# EasyEDA Pro project YanQi_Project.eprj, board PayloadBoard
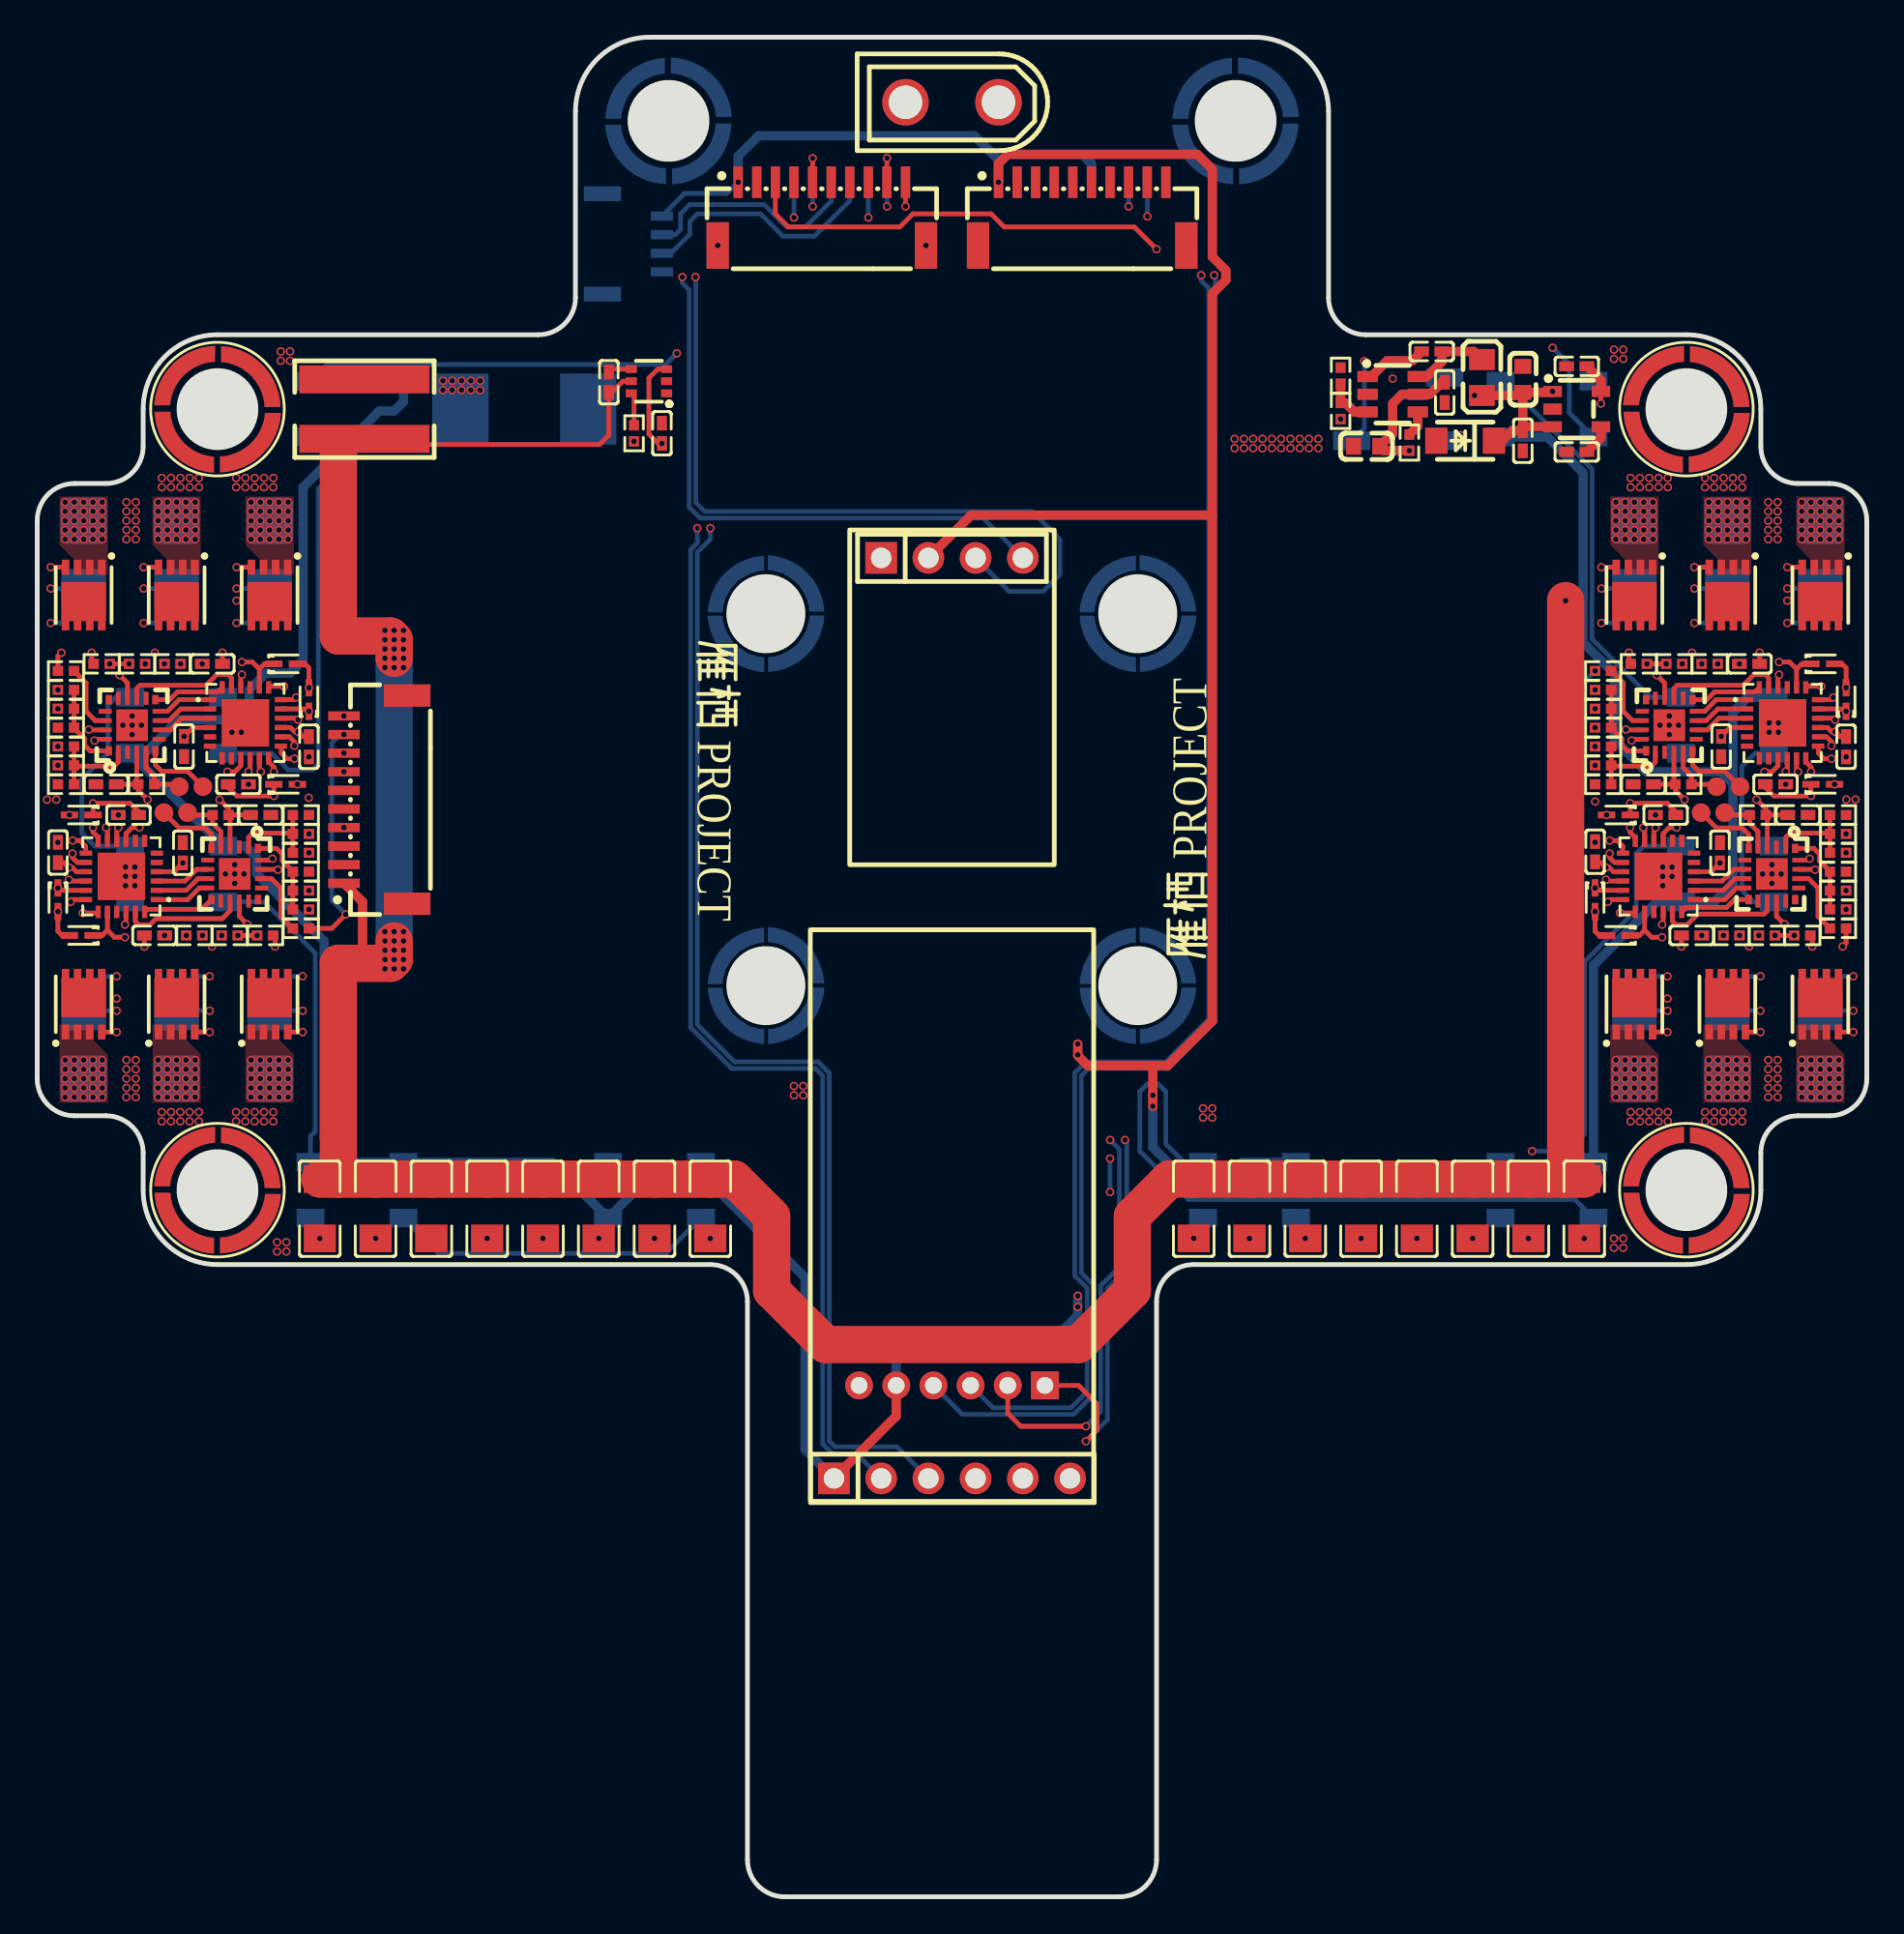
[diagram p6: board, top side]
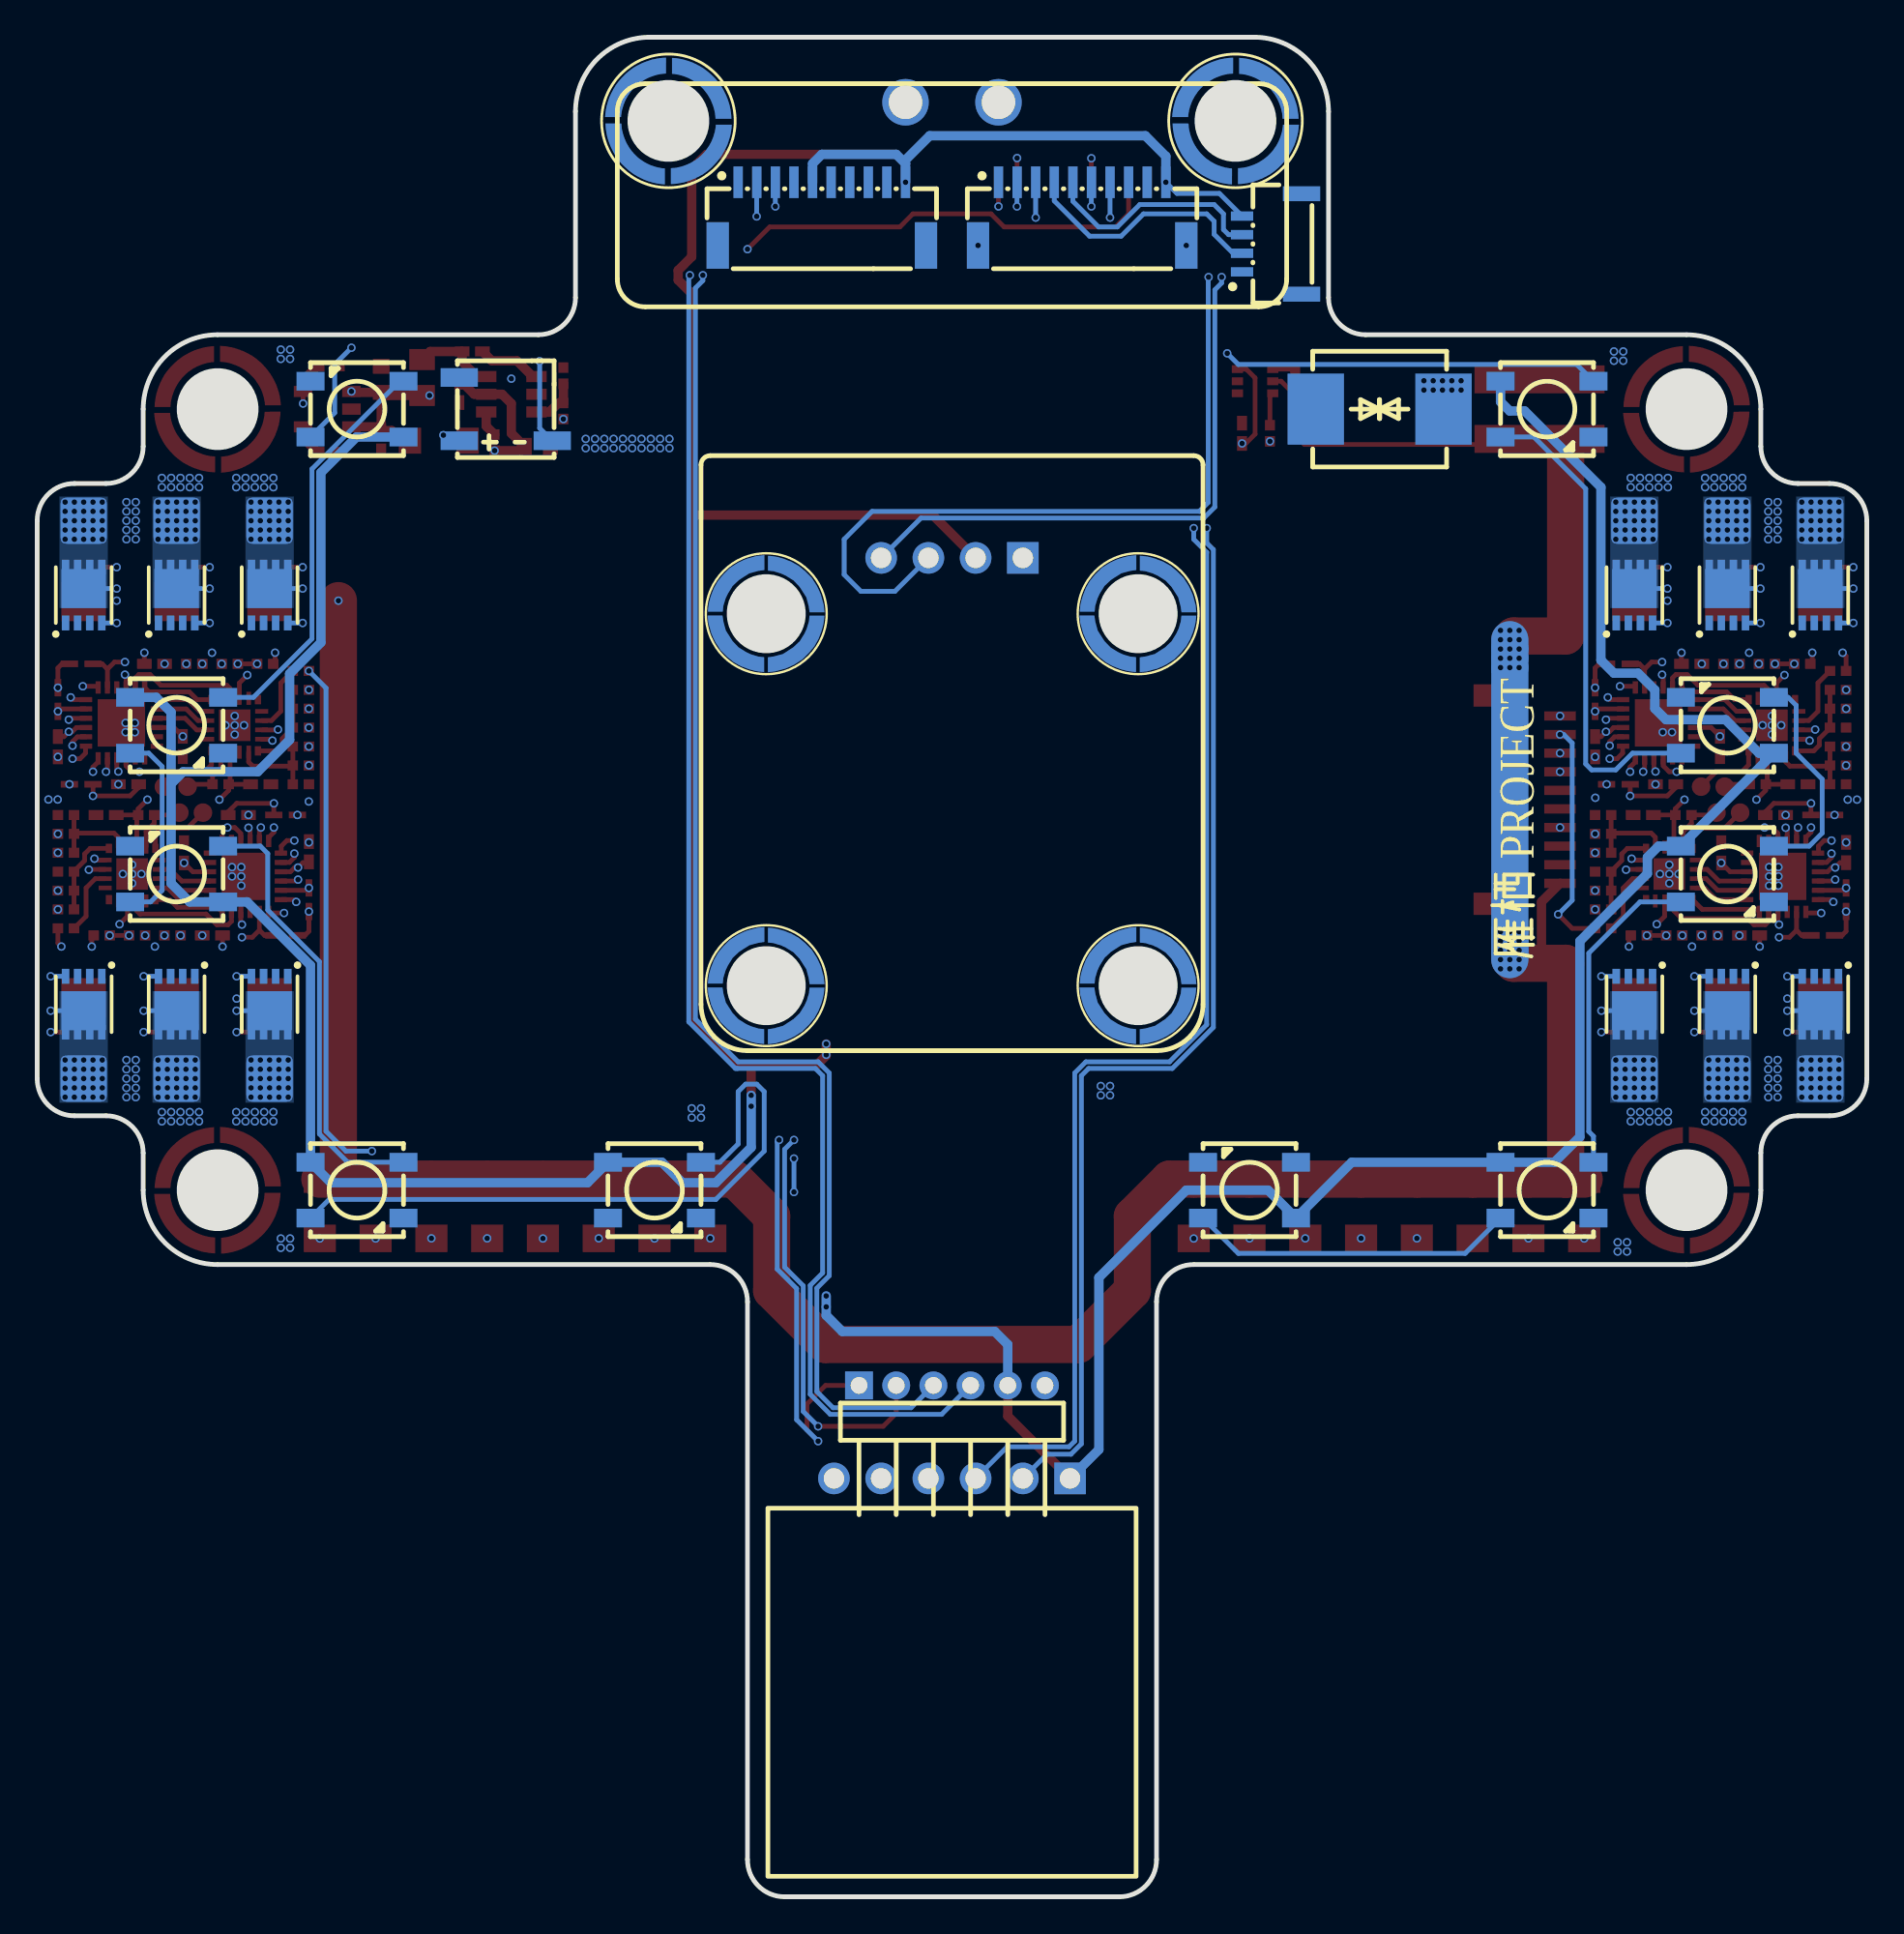
[diagram p7: board, bottom side, seen from below]

Outline 98.4 x 100 mm; copper layers: Top Layer, Inner1, Inner2, Bottom Layer. Coordinates in mm from the lower left corner of the outline.
Outline path: 0,74 0,44 arc(0.59,42.59) 2,42 3.7,42 arc(5.11,41.41) 5.7,40 5.7,38 arc(6.87,35.17) 9.7,34 36.2,34 arc(37.61,33.41) 38.2,32 38.2,2 arc(38.79,0.59) 40.2,0 58.2,0 arc(59.61,0.59) 60.2,2 60.2,32 arc(60.79,33.41) 62.2,34 88.7,34 arc(91.53,35.17) 92.7,38 92.7,40 arc(93.29,41.41) 94.7,42 96.4,42 arc(97.81,42.59) 98.4,44 98.4,74 arc(97.81,75.41) 96.4,76 94.7,76 arc(93.29,76.59) 92.7,78 92.7,80 arc(91.53,82.83) 88.7,84 71.45,84 arc(70.04,84.59) 69.45,86 69.45,96 arc(68.28,98.83) 65.45,100 32.95,100 arc(30.12,98.83) 28.95,96 28.95,86 arc(28.36,84.59) 26.95,84 9.7,84 arc(6.87,82.83) 5.7,80 5.7,78 arc(5.11,76.59) 3.7,76 2,76 arc(0.59,75.41) 0,74
Stack: Top Layer 0.035mm / Dielectric1 0.48mm PP er 4.5 / Inner1 0.035mm / Dielectric2 0.48mm FR4 er 4.5 / Inner2 0.035mm / Dielectric3 0.48mm PP er 4.5 / Bottom Layer 0.035mm

## Design rules (mm)
template: 自定义配置
spacing copperThickness1oz (default): track to track 0.102, other pairs 0.152 to 0.3
spacing copperThickness2oz: track to track 0.203, other pairs 0.152 to 0.3
spacing copperThicknessInner0.5oz: track to track 0.089, other pairs 0.152 to 0.3
track width copperThickness1oz (default): min 0.102, default 0.254, max 10
track width copperThickness2oz: min 0.203, default 0.254, max 10
track width copperThickness0.5oz: min 0.089, default 0.254, max 10
differential pair differentialPair (default): width min 0.127, default 0.254, max 2.54; gap min 0.152, default 0.152
via viaSize (default): diameter min 0.3, default 0.45, max 10; hole min 0.2, default 0.3, max 6.3

## Placement (name value [footprint] x y rotation side)
BUZZER1  4000Hz  [BUZ-SMD_4P-L5.0-W5.0-P4.00-BR]  73.2 80 270 bottom
C1  1uF  [C0402]  92.09 66.3 180 top
C2  1uF  [C0402]  97.29 61.84 270 top
C3  100nF  [C0402_NEW]  86.38 59.83 180 top
C4  100nF  [C0402_NEW]  90.57 61.86 90 top
C5  1uF  [C0402]  93.49 59.83 180 top
C6  1uF  [C0402]  6.31 51.7 0 top
C7  1uF  [C0402]  1.12 56.16 90 top
C8  100nF  [C0402_NEW]  12.02 58.17 0 top
C9  100nF  [C0402_NEW]  7.83 56.14 270 top
C10  1uF  [C0402]  4.91 58.17 0 top
C11  1uF  [C0402]  9.42 66.3 180 top
C12  1uF  [C0402]  14.61 61.84 270 top
C13  100nF  [C0402_NEW]  3.71 59.83 180 top
C14  100nF  [C0402_NEW]  7.9 61.86 90 top
C15  1uF  [C0402]  10.82 59.83 180 top
C16  1uF  [C0402]  88.98 51.7 0 top
C17  1uF  [C0402]  83.79 56.2 90 top
C18  100nF  [C0402_NEW]  94.69 58.17 0 top
C19  100nF  [C0402_NEW]  90.5 56.14 270 top
C20  1uF  [C0402]  87.58 58.17 0 top
C21  100nF  [C0402_NEW]  75 83.1 180 top
C22  100nF  [C0402_NEW]  75.7 80.9 90 top
C23  4.7uF  [C0603]  71.5 78 0 top
C24  10uF  [C0603]  79.9 81.6 270 top
C25  10uF  [C1206]  15.2 37 90 top
C26  10uF  [C1206]  18.2 37 90 top
C27  10uF  [C1206]  21.2 37 90 top
C28  10uF  [C1206]  24.2 37 90 top
C29  10uF  [C1206]  27.2 37 90 top
C30  10uF  [C1206]  30.2 37 90 top
C31  10uF  [C1206]  33.2 37 90 top
C32  10uF  [C1206]  36.2 37 90 top
C33  2.2uF  [C0402]  82.8 82.3 180 top
C34  1uF  [C0402]  79.9 78.3 90 top
C35  100nF  [C0402_NEW]  82.8 77.7 0 top
C36  100nF  [C0402_NEW]  33.6 78.7 270 top
C37  1nF  [C0402]  30.74 81.44 270 top
C38  10uF  [C1206]  62.2 37 90 top
C39  10uF  [C1206]  65.2 37 90 top
C40  10uF  [C1206]  68.2 37 90 top
C41  10uF  [C1206]  71.2 37 90 top
C42  10uF  [C1206]  74.2 37 90 top
C43  10uF  [C1206]  77.2 37 90 top
C44  10uF  [C1206]  80.2 37 90 top
C45  10uF  [C1206]  83.2 37 90 top
CN1  HDGC1002WV-S-4P  [CONN-SMD_4P-P1.00_HDGC_HDGC1002WV-S-4P]  32 88.88 90 bottom
CN2  XT30UPB-M  [CONN-TH_XT30UPB-M]  49.2 96.5 180 top
D1  1N4148WT T4  [SOD-523_L1.2-W0.8-LS1.6-RD]  96.03 66.3 0 top
D2  1N4148WT T4  [SOD-523_L1.2-W0.8-LS1.6-RD]  97.29 64.38 90 top
D3  1N4148WT T4  [SOD-523_L1.2-W0.8-LS1.6-RD]  96.03 59.83 0 top
D4  1N4148WT T4  [SOD-523_L1.2-W0.8-LS1.6-RD]  2.37 51.7 180 top
D5  1N4148WT T4  [SOD-523_L1.2-W0.8-LS1.6-RD]  1.12 53.62 270 top
D6  1N4148WT T4  [SOD-523_L1.2-W0.8-LS1.6-RD]  2.37 58.17 180 top
D7  1N4148WT T4  [SOD-523_L1.2-W0.8-LS1.6-RD]  13.36 66.3 0 top
D8  1N4148WT T4  [SOD-523_L1.2-W0.8-LS1.6-RD]  14.61 64.38 90 top
D9  1N4148WT T4  [SOD-523_L1.2-W0.8-LS1.6-RD]  13.36 59.83 0 top
D10  1N4148WT T4  [SOD-523_L1.2-W0.8-LS1.6-RD]  85.04 51.7 180 top
D11  1N4148WT T4  [SOD-523_L1.2-W0.8-LS1.6-RD]  83.79 53.62 270 top
D12  1N4148WT T4  [SOD-523_L1.2-W0.8-LS1.6-RD]  85.04 58.17 180 top
D13  -  [端口]  95.9 74 180 bottom
D14  -  [端口]  90.9 74 180 bottom
D15  -  [端口]  85.9 74 180 bottom
D16  -  [端口]  12.5 74 180 bottom
D17  -  [端口]  7.5 74 180 bottom
D18  -  [端口]  2.5 74 180 bottom
D19  -  [端口]  2.5 44 180 bottom
D20  -  [端口]  7.5 44 180 bottom
D21  -  [端口]  12.5 44 180 bottom
D22  -  [端口]  85.9 44 180 bottom
D23  -  [端口]  90.9 44 180 bottom
D24  -  [端口]  95.9 44 180 bottom
H1  PZ254V-11-04P  [HDR-TH_4P-P2.54-V-M]  49.2 72 0 top
H2  PZ200-1-06-W  [HDR-TH_6P-P2.00-H-M-W7.2-N]  49.2 27.5 180 bottom
H3  PZ254V-11-06P  [HDR-TH_6P-P2.54-V-M]  49.2 22.5 0 top
L1  6.8uH  [L0805]  77.7 81.7 270 top
LED1  XL-5050RGBC-WS2812B  [LED-SMD_4P-L5.0-W5.0-BL_XL-5050RGBC]  17.2 80 270 bottom
LED2  XL-5050RGBC-WS2812B  [LED-SMD_4P-L5.0-W5.0-BL_XL-5050RGBC]  7.5 63 90 bottom
LED3  XL-5050RGBC-WS2812B  [LED-SMD_4P-L5.0-W5.0-BL_XL-5050RGBC]  7.5 55 270 bottom
LED4  XL-5050RGBC-WS2812B  [LED-SMD_4P-L5.0-W5.0-BL_XL-5050RGBC]  17.2 38 270 bottom
LED5  XL-5050RGBC-WS2812B  [LED-SMD_4P-L5.0-W5.0-BL_XL-5050RGBC]  33.2 38 90 bottom
LED6  XL-5050RGBC-WS2812B  [LED-SMD_4P-L5.0-W5.0-BL_XL-5050RGBC]  65.2 38 270 bottom
LED7  XL-5050RGBC-WS2812B  [LED-SMD_4P-L5.0-W5.0-BL_XL-5050RGBC]  81.2 38 270 bottom
LED8  XL-5050RGBC-WS2812B  [LED-SMD_4P-L5.0-W5.0-BL_XL-5050RGBC]  90.9 55 90 bottom
LED9  XL-5050RGBC-WS2812B  [LED-SMD_4P-L5.0-W5.0-BL_XL-5050RGBC]  90.9 63 270 bottom
LED10  XL-5050RGBC-WS2812B  [LED-SMD_4P-L5.0-W5.0-BL_XL-5050RGBC]  81.2 80 90 bottom
Q1  AON7544  [DFN-8_L3.0-W3.0-P0.65-BL]  95.9 70 180 top
Q2  AON7544  [DFN-8_L3.0-W3.0-P0.65-BL]  90.9 70 180 top
Q3  AON7544  [DFN-8_L3.0-W3.0-P0.65-BL]  85.9 70 180 top
Q4  AON7544  [DFN-8_L3.0-W3.0-P0.65-BL]  12.5 70 180 top
Q5  AON7544  [DFN-8_L3.0-W3.0-P0.65-BL]  7.5 70 180 top
Q6  AON7544  [DFN-8_L3.0-W3.0-P0.65-BL]  2.5 70 180 top
Q7  AON7544  [DFN-8_L3.0-W3.0-P0.65-BL]  95.9 70 180 bottom
Q8  AON7544  [DFN-8_L3.0-W3.0-P0.65-BL]  90.9 70 180 bottom
Q9  AON7544  [DFN-8_L3.0-W3.0-P0.65-BL]  85.9 70 180 bottom
Q10  AON7544  [DFN-8_L3.0-W3.0-P0.65-BL]  12.5 70 180 bottom
Q11  AON7544  [DFN-8_L3.0-W3.0-P0.65-BL]  7.5 70 180 bottom
Q12  AON7544  [DFN-8_L3.0-W3.0-P0.65-BL]  2.5 70 180 bottom
Q13  AON7544  [DFN-8_L3.0-W3.0-P0.65-BL]  2.5 48 0 top
Q14  AON7544  [DFN-8_L3.0-W3.0-P0.65-BL]  7.5 48 0 top
Q15  AON7544  [DFN-8_L3.0-W3.0-P0.65-BL]  12.5 48 0 top
Q16  AON7544  [DFN-8_L3.0-W3.0-P0.65-BL]  85.9 48 0 top
Q17  AON7544  [DFN-8_L3.0-W3.0-P0.65-BL]  90.9 48 0 top
Q18  AON7544  [DFN-8_L3.0-W3.0-P0.65-BL]  95.9 48 0 top
Q19  AON7544  [DFN-8_L3.0-W3.0-P0.65-BL]  2.5 48 0 bottom
Q20  AON7544  [DFN-8_L3.0-W3.0-P0.65-BL]  7.5 48 0 bottom
Q21  AON7544  [DFN-8_L3.0-W3.0-P0.65-BL]  12.5 48 0 bottom
Q22  AON7544  [DFN-8_L3.0-W3.0-P0.65-BL]  85.9 48 0 bottom
Q23  AON7544  [DFN-8_L3.0-W3.0-P0.65-BL]  90.9 48 0 bottom
Q24  AON7544  [DFN-8_L3.0-W3.0-P0.65-BL]  95.9 48 0 bottom
R1  10K  [R0402]  84.22 65.92 180 top
R2  47K  [R0402]  84.22 61.86 180 top
R3  47K  [R0402]  86.14 66.3 180 top
R4  47K  [R0402]  84.22 64.91 180 top
R5  10K  [R0402]  84.22 60.84 0 top
R6  10K  [R0402]  88.04 66.3 180 top
R7  1K  [R0402]  88.54 59.83 0 top
R8  10K  [R0402]  84.22 63.89 0 top
R9  4.7K  [R0402]  84.22 59.83 0 top
R10  4.7K  [R0402]  89.95 66.3 0 top
R11  4.7K  [R0402]  84.22 62.87 0 top
R12  10K  [R0402]  14.18 52.08 0 top
R13  47K  [R0402]  14.18 56.14 0 top
R14  47K  [R0402]  12.26 51.7 0 top
R15  47K  [R0402]  14.18 53.09 0 top
R16  10K  [R0402]  14.18 57.16 180 top
R17  10K  [R0402]  10.36 51.7 0 top
R18  1K  [R0402]  9.86 58.17 180 top
R19  10K  [R0402]  14.18 54.11 180 top
R20  4.7K  [R0402]  14.18 58.17 180 top
R21  4.7K  [R0402]  8.45 51.7 180 top
R22  4.7K  [R0402]  14.18 55.13 180 top
R23  10K  [R0402]  1.55 65.92 180 top
R24  47K  [R0402]  1.55 61.86 180 top
R25  47K  [R0402]  3.47 66.3 180 top
R26  47K  [R0402]  1.55 64.91 180 top
R27  10K  [R0402]  1.55 60.84 0 top
R28  10K  [R0402]  5.37 66.3 180 top
R29  1K  [R0402]  5.87 59.83 0 top
R30  10K  [R0402]  1.55 63.89 0 top
R31  4.7K  [R0402]  1.55 59.83 0 top
R32  4.7K  [R0402]  7.28 66.3 0 top
R33  4.7K  [R0402]  1.55 62.87 0 top
R34  10K  [R0402]  96.85 52.08 0 top
R35  47K  [R0402]  96.85 56.14 0 top
R36  47K  [R0402]  94.93 51.7 0 top
R37  47K  [R0402]  96.85 53.09 0 top
R38  10K  [R0402]  96.85 57.16 180 top
R39  10K  [R0402]  93.03 51.7 0 top
R40  1K  [R0402]  92.53 58.17 180 top
R41  10K  [R0402]  96.85 54.11 180 top
R42  4.7K  [R0402]  96.85 58.17 180 top
R43  4.7K  [R0402]  91.12 51.7 180 top
R44  4.7K  [R0402]  96.85 55.13 180 top
R45  100kΩ  [R0402]  73.8 78.2 270 top
R46  10K  [R0402]  70.1 81.8 270 top
R47  90.9kΩ  [R0402]  70.1 79.9 270 top
R48  56Ω  [R0402]  32.1 78.7 270 top
R49  10mΩ  [R1225]  17.6 80 90 top
U1  EFM8BB21F16G-C-QFN20R  [QFN-20_L3.0-W3.0-P0.50-BL-EP1.7_EFM8BB21F16G]  87.78 63 0 top
U2  FD6288Q  [QFN-24_L4.0-W4.0-P0.50-BL-EP2.6]  93.87 63.13 270 top
U3  EFM8BB21F16G-C-QFN20R  [QFN-20_L3.0-W3.0-P0.50-BL-EP1.7_EFM8BB21F16G]  10.62 55 180 top
U4  FD6288Q  [QFN-24_L4.0-W4.0-P0.50-BL-EP2.6]  4.53 54.87 90 top
U5  EFM8BB21F16G-C-QFN20R  [QFN-20_L3.0-W3.0-P0.50-BL-EP1.7_EFM8BB21F16G]  5.11 63 0 top
U6  FD6288Q  [QFN-24_L4.0-W4.0-P0.50-BL-EP2.6]  11.2 63.13 270 top
U7  EFM8BB21F16G-C-QFN20R  [QFN-20_L3.0-W3.0-P0.50-BL-EP1.7_EFM8BB21F16G]  93.29 55 180 top
U8  FD6288Q  [QFN-24_L4.0-W4.0-P0.50-BL-EP2.6]  87.2 54.87 90 top
U9  JW5026  [SOT-23-6_L2.9-W1.6-P0.95-LS2.8-BR]  72.9 80.8 180 top
U10  -  [烧录点]  90.32 59.7 0 top
U11  -  [烧录点]  8.09 58.3 180 top
U12  -  [烧录点]  7.64 59.7 0 top
U13  -  [烧录点]  90.76 58.3 0 top
U14  SMF8.0A  [SOD-123FL_L2.8-W1.8-LS3.6-RD]  76.8 78.3 180 top
U15  -  [烧录点]  91.58 59.7 0 top
U16  -  [烧录点]  6.81 58.3 180 top
U17  -  [烧录点]  8.91 59.7 0 top
U18  -  [烧录点]  89.49 58.3 0 top
U19  INA199A1DCKR  [SC-70-6_L2.2-W1.3-P0.65-LS2.1-BR]  32.9 81.5 0 top
U20  SMDJ28CA  [SMC_L6.9-W5.9-LS7.9-BI]  26.2 80 0 bottom
U21  AP2210K-3.3TRG1  [SOT-23-5_L3.0-W1.7-P0.95-LS2.8-BR]  82.8 80 180 top
U22  SMTSO3050CTJ  [SMD_SMTSO3060CTJ]  9.7 80 0 top
U23  SMTSO3050CTJ  [SMD_SMTSO3060CTJ]  88.7 80 0 top
U24  SMTSO3050CTJ  [SMD_SMTSO3060CTJ]  9.7 38 0 top
U25  SMTSO3050CTJ  [SMD_SMTSO3060CTJ]  88.7 38 0 top
U26  WAFER-SH1.0-10PWB  [CONN-SMD_10P-P1.00_WAFER-SH1.0-10PWB]  42.2 90.5 0 top
U27  WAFER-SH1.0-10PWB  [CONN-SMD_10P-P1.00_WAFER-SH1.0-10PWB]  56.2 90.5 0 top
U28  WAFER-SH1.0-10PWB  [CONN-SMD_10P-P1.00_WAFER-SH1.0-10PWB]  18.2 59 90 top
U29  SMTSO3015CTJ  [SMD_BD5.6-L5.6-W5.6-D4.1]  59.2 49 180 bottom
U30  SMTSO3015CTJ  [SMD_BD5.6-L5.6-W5.6-D4.1]  39.2 49 180 bottom
U31  SMTSO3015CTJ  [SMD_BD5.6-L5.6-W5.6-D4.1]  59.2 69 180 bottom
U32  SMTSO3015CTJ  [SMD_BD5.6-L5.6-W5.6-D4.1]  39.2 69 180 bottom
U33  SMTSO3050CTJ  [SMD_SMTSO3060CTJ]  33.95 95.5 180 bottom
U34  SMTSO3050CTJ  [SMD_SMTSO3060CTJ]  64.45 95.5 180 bottom
U35  WAFER-SH1.0-10PWB  [CONN-SMD_10P-P1.00_WAFER-SH1.0-10PWB]  42.2 90.5 180 bottom
U36  WAFER-SH1.0-10PWB  [CONN-SMD_10P-P1.00_WAFER-SH1.0-10PWB]  56.2 90.5 180 bottom

## Footprints (pads in the part's own frame, mm; a bottom-side part is the same pattern mirrored in y, then rotated)
BUZ-SMD_4P-L5.0-W5.0-P4.00-BR
  rect 1x2 smd: 1(1.7,-2.5) 2(1.7,2.5) 3(-1.7,-2.5)
C0402
  rect 0.79x0.54 smd: 1(-0.545,0) 2(0.545,0)
C0402_NEW
  rect 0.79x0.54 smd: 1(-0.545,0) 2(0.545,0)
C0603
  rect 0.8x0.9 smd: 1(-0.7,0) 2(0.7,0)
C1206
  rect 1.485x1.728 smd: 1(-1.593,0) 2(1.593,0)
CONN-SMD_4P-P1.00_HDGC_HDGC1002WV-S-4P
  rect 0.5x1.2 smd: 1(-1.5,1.6) 2(-0.5,1.6) 3(0.5,1.6) 4(1.5,1.6)
  rect 0.8x2 smd: 5(2.7,-1.6) 6(-2.7,-1.6)
CONN-SMD_10P-P1.00_WAFER-SH1.0-10PWB
  rect 0.5x1.7 smd: 1(-4.5,1.7) 2(-3.5,1.7) 3(-2.5,1.7) 4(-1.5,1.7) 5(-0.5,1.7) 6(0.5,1.7) 7(1.5,1.7) 8(2.5,1.7) 9(3.5,1.7) 10(4.5,1.7)
  rect 1.2x2.5 smd: 11(5.6,-1.7) 12(-5.6,-1.7)
CONN-TH_XT30UPB-M
  round 2.5 hole 1.8: 1(-2.5,0) 2(2.5,0)
DFN-8_L3.0-W3.0-P0.65-BL
  rect 0.4x0.8 smd: 1(-0.975,-1.5) 2(-0.325,-1.5) 3(0.325,-1.5) 4(0.975,-1.5) 5(0.975,1.5) 6(0.325,1.5) 7(-0.325,1.5) 8(-0.975,1.5)
  rect 2.4x2.1 smd: 9(0,0.35)
HDR-TH_4P-P2.54-V-M
  rect 1.7x1.7 hole 1.1: 1(-3.81,0)
  round 1.7 hole 1.1: 2(-1.27,0) 3(1.27,0) 4(3.81,0)
HDR-TH_6P-P2.00-H-M-W7.2-N
  rect 1.5x1.5 hole 0.9: 1(-5,0)
  round 1.5 hole 0.9: 2(-3,0) 3(-1,0) 4(1,0) 5(3,0) 6(5,0)
HDR-TH_6P-P2.54-V-M
  rect 1.7x1.7 hole 1.1: 1(-6.35,0)
  round 1.7 hole 1.1: 2(-3.81,0) 3(-1.27,0) 4(1.27,0) 5(3.81,0) 6(6.35,0)
L0805
  rect 1.133x1.377 smd: 1(-0.966,0) 2(0.966,0)
LED-SMD_4P-L5.0-W5.0-BL_XL-5050RGBC
  rect 1x1.5 smd: 1(-1.5,-2.5) 2(1.5,-2.5) 3(1.5,2.5) 4(-1.5,2.5)
QFN-20_L3.0-W3.0-P0.50-BL-EP1.7_EFM8BB21F16G
  rect 0.34x0.5 smd: 1(-1.252,-1.377) 6(1.248,-1.377) 11(1.248,1.377) 16(-1.252,1.377)
  rect 0.25x0.7 smd: 2(-0.751,-1.45) 3(-0.252,-1.45) 4(0.248,-1.45) 5(0.749,-1.45) 12(0.749,1.45) 13(0.248,1.45) 14(-0.252,1.45) 15(-0.751,1.45)
  rect 0.7x0.25 smd: 7(1.452,-0.75) 8(1.452,-0.25) 9(1.452,0.25) 10(1.452,0.75) 17(-1.452,0.75) 18(-1.452,0.25) 19(-1.452,-0.25) 20(-1.452,-0.75)
  rect 1.7x1.7 smd: 21(-0.002,0)
QFN-24_L4.0-W4.0-P0.50-BL-EP2.6
  rect 0.28x0.665 smd: 1(-1.25,-1.907) 2(-0.75,-1.907) 3(-0.25,-1.907) 4(0.25,-1.907) 5(0.75,-1.907) 6(1.25,-1.907) 13(1.25,1.907) 14(0.75,1.907) 15(0.25,1.907) 16(-0.25,1.907) 17(-0.75,1.907) 18(-1.25,1.907)
  rect 0.665x0.28 smd: 7(1.907,-1.25) 8(1.907,-0.75) 9(1.907,-0.25) 10(1.907,0.25) 11(1.907,0.75) 12(1.907,1.25) 19(-1.907,1.25) 20(-1.907,0.75) 21(-1.907,0.25) 22(-1.907,-0.25) 23(-1.907,-0.75) 24(-1.907,-1.25)
  rect 2.55x2.55 smd: 25(0,0)
R0402
  rect 0.566x0.54 smd: 1(-0.433,0) 2(0.433,0)
R1225
  rect 1.5x7 smd: 1(-1.6,0) 2(1.6,0)
SC-70-6_L2.2-W1.3-P0.65-LS2.1-BR
  rect 0.6x0.42 smd: 1(0.95,-0.65) 2(0.95,0) 3(0.95,0.65) 4(-0.95,0.65) 5(-0.95,0) 6(-0.95,-0.65)
SMC_L6.9-W5.9-LS7.9-BI
  rect 3.03x3.82 smd: 1(-3.435,0) 2(3.435,0)
SMD_BD5.6-L5.6-W5.6-D4.1
  custom 3.04x3.04 smd: 1(-1.623,-2.167) 1(-1.609,2.171) 1(1.617,-2.171) 1(1.623,2.141)
SMD_SMTSO3060CTJ
  custom 3.197x3.279 smd: 1(-1.79,-2.369)
  custom 3.279x3.197 smd: 1(-1.769,2.386) 1(1.768,-2.386)
  custom 3.197x3.278 smd: 1(1.79,2.34)
SOD-123FL_L2.8-W1.8-LS3.6-RD
  rect 1.2x1.4 smd: 1(-1.55,0) 2(1.55,0)
SOD-523_L1.2-W0.8-LS1.6-RD
  rect 0.93x0.36 smd: 1(-0.635,0) 2(0.635,0)
SOT-23-5_L3.0-W1.7-P0.95-LS2.8-BR
  rect 1x0.6 smd: 1(1.3,-0.95) 2(1.3,0) 3(1.3,0.95) 4(-1.3,0.95) 5(-1.3,-0.95)
SOT-23-6_L2.9-W1.6-P0.95-LS2.8-BR
  rect 1.1x0.6 smd: 1(1.35,-0.95) 2(1.35,0) 3(1.35,0.95) 4(-1.35,0.95) 5(-1.35,0) 6(-1.35,-0.95)
烧录点
  round 1 smd: 1(0,0)
端口
  rrect 2.5x2.5 smd: 1(0,0)

## Nets
As in the schematic.

Pads without a net: BUZZER1 3; H3 5; LED5 2; LED6 2; U1 7 15 16 17; U2 5 7 8 21; U3 7 15 16 17; U4 5 7 8 21; U5 7 15 16 17; U6 5 7 8 21; U7 7 15 16 17; U8 5 7 8 21

## Via types
v1: diameter 0.45, hole 0.3, Top Layer to Bottom Layer, 802 vias

## Routing (per net, layer and track width the routed paths; a pad name or vN(x,y) marks a point on that pad's centre or on a via; arc(x,y) is an arc through that point)
3.3V: length 229.5
  Top Layer w0.254: R7.1 88.03,59.9 U1.4 ; R7.1 86.92,59.83 ; R7.1 88.1,59.5 v1(88.6,59) ; v1(92.47,59) 92.97,58.5 R40.1 ; 33.75,82.15 33.37,82.15 32.9,81.68 32.9,78.66 33.4,78.16 v1(33.6,78.16) ; R40.1 C18.1 ; R40.1 93.04,58.1 U7.4 ; v1(5.94,59) 5.44,59.5 5.44,59.83 ; 10.3,58.17 10.3,58.5 v1(9.81,59) ; U5.4 5.36,59.9 R29.1 C13.1 ; v1(84.1,80.3) U21.5 ; U3.4 10.37,58.1 R18.1 C8.1
  Top Layer w0.5: U21.5 84.1,81.55 C33.1
  Inner1 w0.254: v1(92.47,59) v1(88.6,59) ; v1(5.94,59) v1(9.81,59)
  Inner2 w0.254: 82.93,60.18 82.93,77.33 84.1,78.5 v1(84.1,80.3) 78.25,80.3 v1(76.55,78.6) ; 82.93,60.18 82.93,52.87 83.7,52.1 83.7,39.7 82.6,38.6 57.69,38.6 57.2,38.11 57.2,31.1 56.34,30.24 41.66,30.24 41.2,30.71 41.2,33.3 35.1,39.4 16.9,39.4 15.47,40.83 15.47,57.82 ; 82.93,60.18 83.59,59.52 88.08,59.52 v1(88.6,59) ; v1(9.81,59) 10.21,58.6 15,58.6 15.47,58.13 ; 15.47,58.13 15.47,57.82 ; 15.47,58.13 15.47,76.07 17.16,77.76 33.26,77.76 33.6,78.1 v1(33.6,78.16) ; 15.47,58.13 15.47,57.82
5V: length 335
  Top Layer w0.5: 63.2,74.23 63.2,47.1 60.8,44.7 59.98,44.7 ; 63.2,74.23 63.13,74.3 50.23,74.3 H1.2 ; 63.2,74.23 63.2,86.21 63.93,86.94 63.93,87.46 63.2,88.19 63.2,92.9 62.4,93.7 52.2,93.7 51.7,93.2 v1(51.7,92.2) ; v1(55.96,45.86) 55.96,45.23 56.5,44.7 59.98,44.7 ; H3.1 46.2,25.85 H2.5 ; 59.98,44.7 60,44.69 v1(60,43.1) v1(60,42.51)
  Inner1 w0.5: 55.96,31.68 v1(55.96,32.31) v1(55.96,45.28) v1(55.96,45.86)
  Bottom Layer w0.254: v1(37.7,92.2) 37.1,91.6 34.82,91.6 CN1.4
  Bottom Layer w0.5: U36.5 56.7,93.2 56.2,93.7 52.2,93.7 51.7,93.2 ; LED10.1 81.22,78.5 83.14,76.58 83.14,67.45 84.82,65.77 84.82,62.22 86.54,60.5 90.55,60.5 91.2,59.85 ; H3.1 41.3,24.05 41.3,33.3 36.6,38 32.2,38 LED5.1 27.7,39.5 LED4.1 16.8,39.5 15.43,40.87 15.43,51.39 11.8,55.02 11.8,55.9 11.2,56.5 LED3.1 LED2.1 5.8,61.5 7.6,63.3 10.8,63.3 11.4,63.9 11.4,64.9 12.3,65.8 13.6,65.8 14.3,66.5 14.3,75.8 18.4,79.9 19.21,79.9 19.7,80.39 LED1.1 ; 51.7,93.2 51.7,93.4 50.4,94.7 38.8,94.7 37.7,93.6 v1(37.7,92.2) ; 51.7,93.2 v1(51.7,92.2) ; v1(60,43.1) v1(60,42.51) 60,40.3 61.9,38.4 63.7,38.4 64.8,39.5 LED6.1 68.8,38.4 82.6,38.4 LED7.1 83.7,50.09 87.11,53.5 LED8.1 90.2,53.5 91.2,54.5 91.2,59.85 ; v1(55.96,32.31) v1(55.96,31.72) 55.96,31.27 55.1,30.4 46.9,30.4 46.2,29.7 H2.5 ; 91.2,59.85 91.2,63.7 92,64.5 LED9.1
8V: length 258.1
  Top Layer w0.254: v1(7.9,62.4) 8.37,62.88 U6.4 ; D10.2 84.01,51.7 83.79,51.92 v1(83.79,52.98) ; v1(14.61,65.02) 14.61,66.08 14.39,66.3 D7.2 ; v1(7.83,55.6) 7.36,55.12 U4.4 ; v1(90.57,62.4) 91.04,62.88 U2.4 ; U8.4 90.03,55.12 v1(90.5,55.6) ; v1(1.12,52.98) 1.12,51.92 1.34,51.7 D4.2 ; v1(97.29,65.02) 97.29,66.08 97.07,66.3 D1.2
  Top Layer w0.5: C24.2 C34.2 ; C24.2 81.45,80.9 v1(81.5,80.95) ; C24.2 79.73,80.73 v1(77.3,80.73) ; C34.2 79.33,78.84 78.78,78.3 U14.1 ; C34.2 80.11,79.05 U21.3
  Inner1 w0.254: v1(96.67,59.83) 96.67,59.47 95.89,58.7 94.45,58.7 93.15,60 84.89,60 84.41,59.52 v1(84.41,58.17) 84.38,58.2 83.4,58.2 82.93,58.67 ; v1(13.99,59.83) 14.98,59.83 15.47,59.33 15.47,40.83 17.6,38.7 35.9,38.7 41.3,33.3 41.3,30.71 41.76,30.24 56.34,30.24 57.2,31.1 57.2,38.11 57.69,38.6 80.8,38.6 82.93,40.73 82.93,58.67 ; 1.73,58.17 1.73,58.53 2.5,59.3 3.95,59.3 5.25,58 13.51,58 13.99,58.48 13.99,59.83 ; 82.93,58.67 82.93,79.52 v1(81.5,80.95)
  Inner1 w0.5: v1(70.1,79.47) 76.03,79.47 v1(77.3,80.73)
  Inner2 w0.254: v1(7.9,62.4) 8.44,61.86 12.14,61.86 13.99,60.01 v1(13.99,59.83) 15.12,60.95 15.12,64.52 v1(14.61,65.02) ; 90.5,55.6 89.95,56.14 86.25,56.14 84.4,57.99 84.4,58.17 83.28,57.06 83.28,53.48 83.78,52.98 ; 97.29,65.02 97.79,64.53 97.79,60.95 96.67,59.83 96.67,60.01 94.83,61.86 91.13,61.86 90.57,62.41 ; v1(1.12,52.98) 0.61,53.48 0.61,57.05 v1(1.73,58.17) 1.73,57.99 3.73,56 7.43,56 v1(7.83,55.6)